# EasyEDA Pro project FPGA-G1.eprj, board logi Pi (continued)
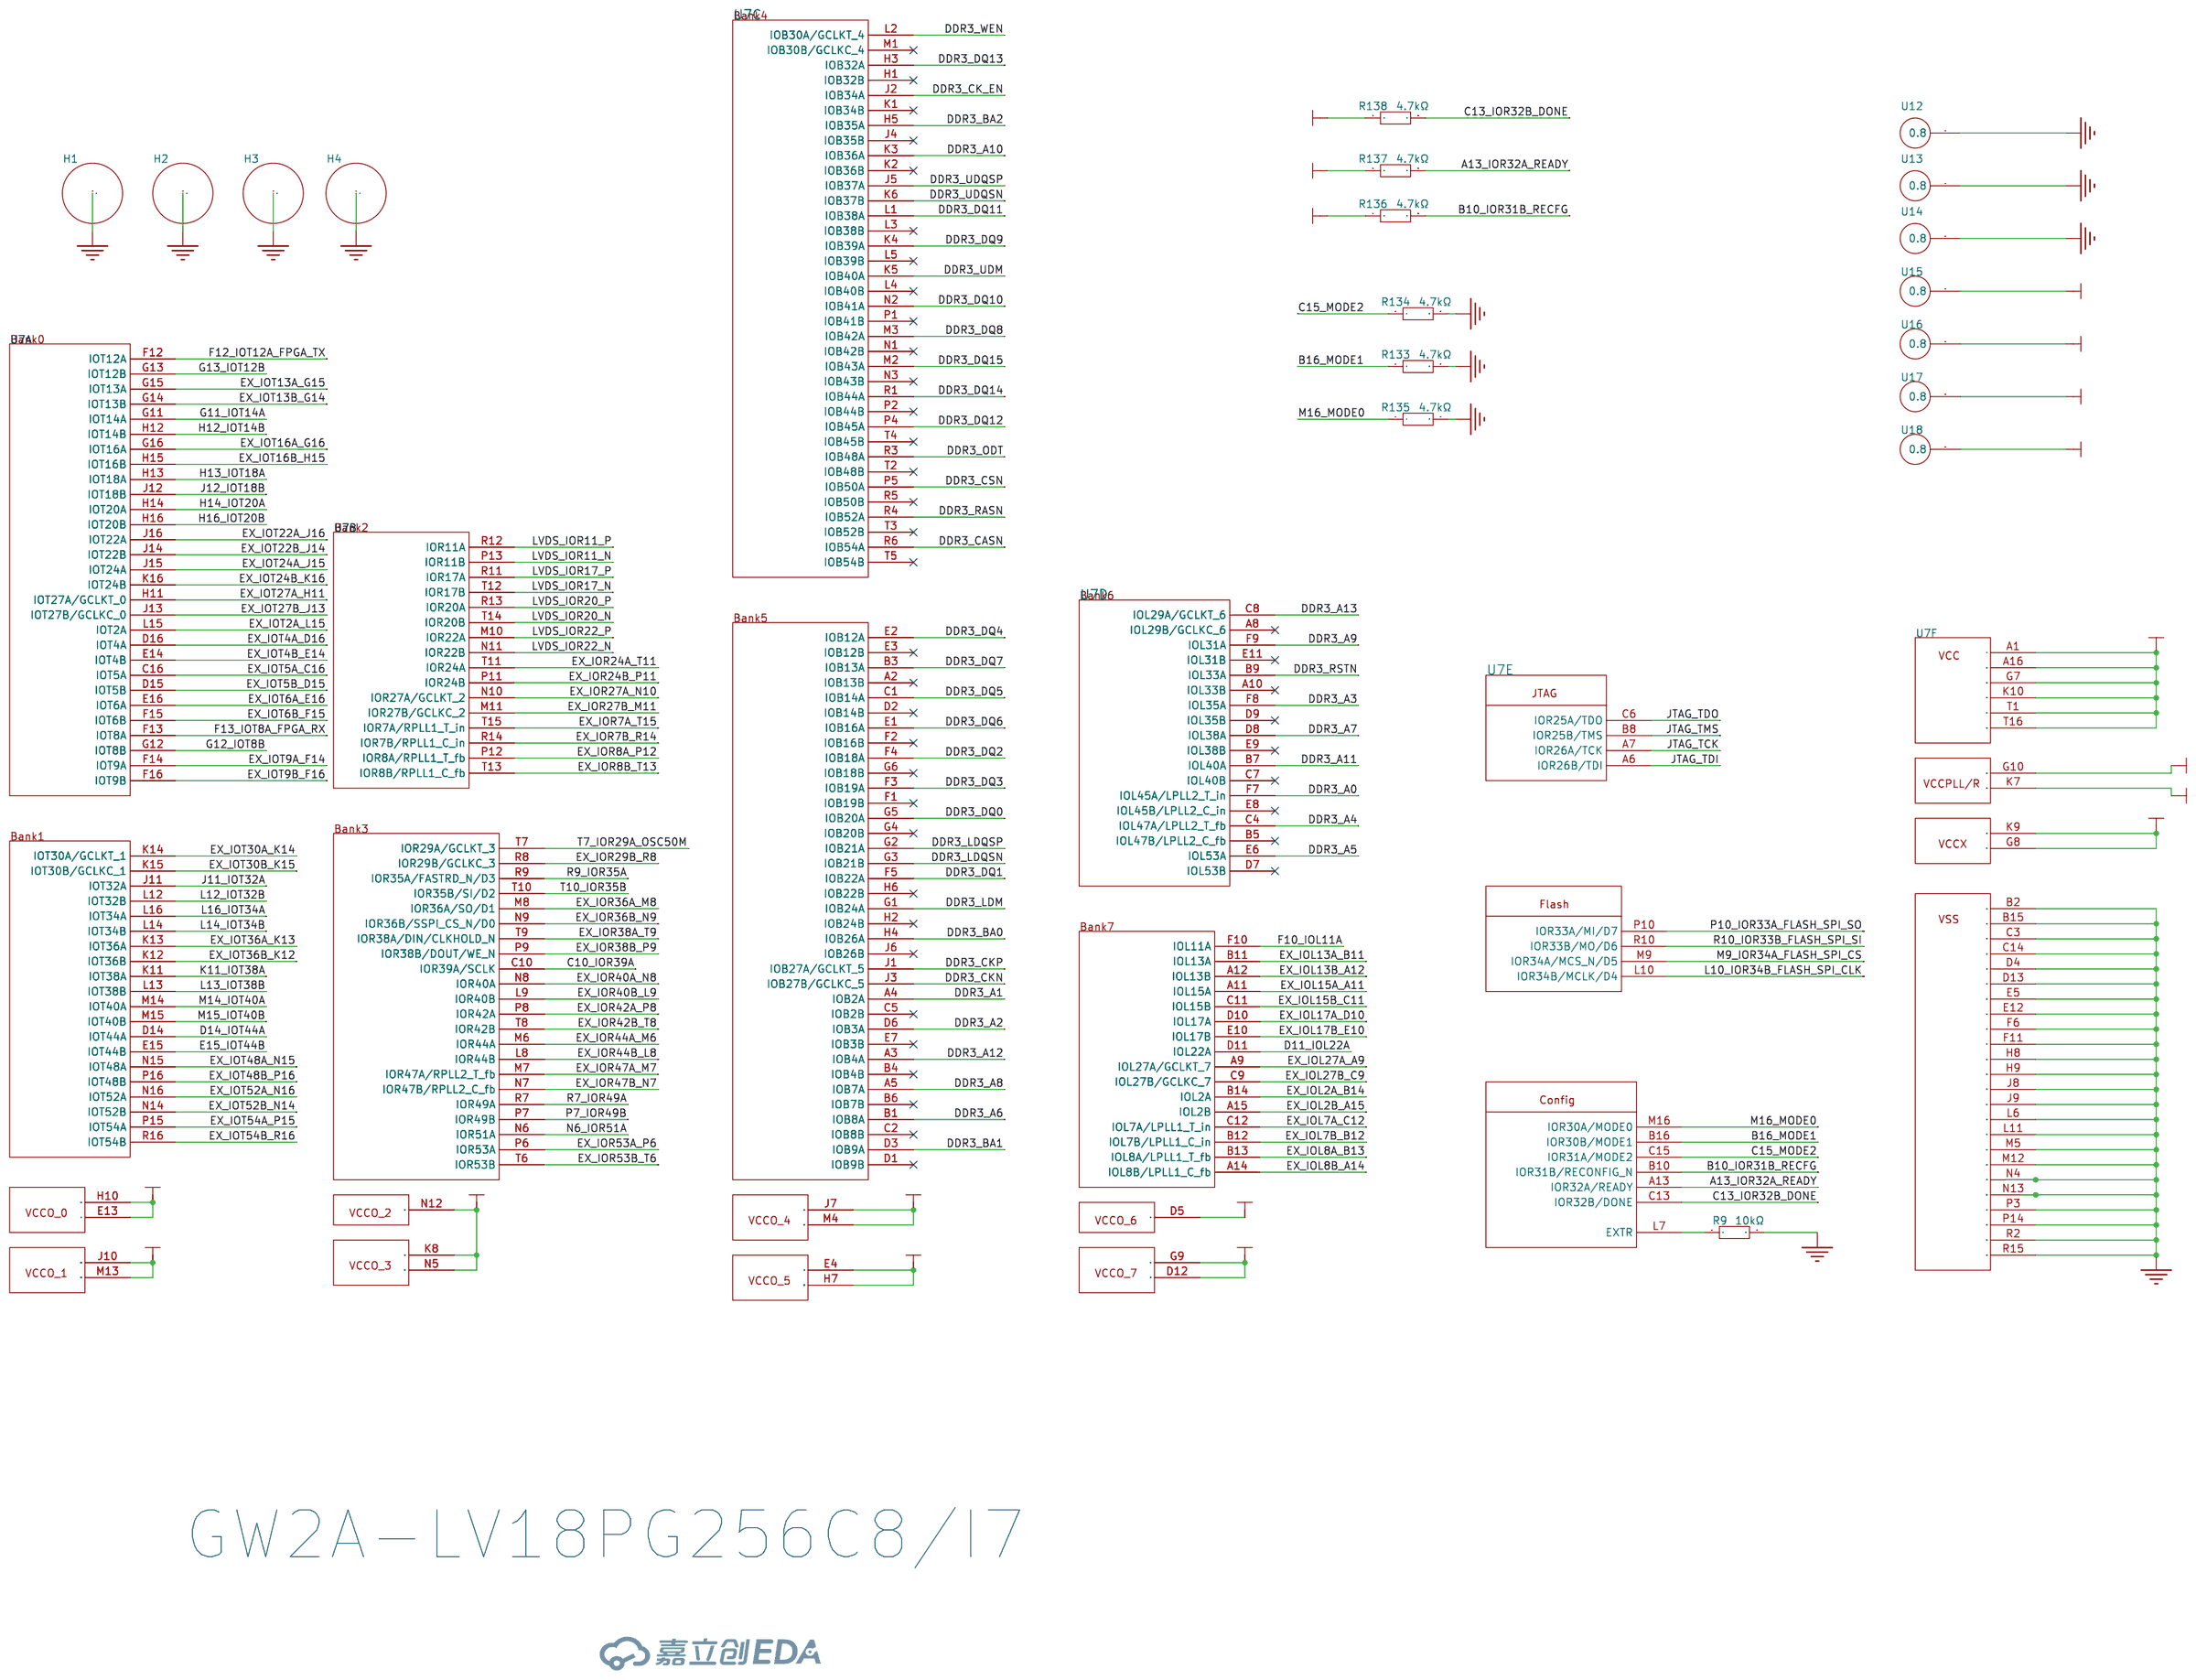
[diagram p0: FPGA]
## Routing (per net, layer and track width the routed paths; a pad name or vN(x,y) marks a point on that pad's centre or on a via; arc(x,y) is an arc through that point) (continued)
  SIG04 w0.104: 31.36,34.74 31.69,35.08 v1(31.71,35.08) ; 32.5,32.69 32.29,32.89 32.29,33.24 ; 41.57,25.03 41.57,24.49 41.46,24.38 40.61,24.38 40.37,24.63 40.37,26.01 40,26.37 38.28,26.37 37.9,26.75 37.9,32.55 36.48,33.98 35.29,33.98
EX_IOT48A_N15: length 22
  Top Layer w0.104: v1(35.7,31.09) 34.7,31.09 U7.N15
  SIG04 w0.104: v1(35.7,31.09) 36.05,30.74 36.05,30.28 36.49,29.84 36.49,29.23 36.74,28.98 36.91,28.98 36.98,28.91 36.98,28.73 36.91,28.65 36.74,28.65 36.49,28.4 36.49,27.97 36.74,27.71 36.91,27.71 36.98,27.64 36.98,27.46 36.91,27.39 36.74,27.39 36.49,27.13 36.49,26.7 36.74,26.45 36.91,26.45 36.98,26.38 36.98,26.2 36.91,26.12 36.74,26.12 36.49,25.87 36.49,25.44 36.74,25.18 36.91,25.18 36.98,25.11 36.98,24.93 36.91,24.86 36.74,24.86 36.49,24.61 36.49,24.17 36.74,23.92 36.91,23.92 36.98,23.85 36.98,23.67 36.91,23.59 36.74,23.59 36.49,23.34 36.49,21.71 36.78,21.42 37.43,21.42 37.95,21.95 37.95,23.14 38.42,23.61 40.07,23.61 40.15,23.53 40.15,22.56 40.07,22.49 H6.31
EX_IOT48B_P16: length 22
  Top Layer w0.104: v1(36.7,31.09) 36.2,30.59 U7.P16
  SIG04 w0.104: v1(36.7,31.09) 36.35,30.74 36.35,30.41 36.8,29.97 36.8,29.36 36.87,29.28 37.04,29.28 37.29,29.03 37.29,28.6 37.04,28.35 36.87,28.35 36.8,28.27 36.8,28.09 36.87,28.02 37.04,28.02 37.29,27.77 37.29,27.33 37.04,27.08 36.87,27.08 36.8,27.01 36.8,26.83 36.87,26.75 37.04,26.75 37.29,26.5 37.29,26.07 37.04,25.82 36.87,25.82 36.8,25.74 36.8,25.56 36.87,25.49 37.04,25.49 37.29,25.24 37.29,24.8 37.04,24.55 36.87,24.55 36.8,24.48 36.8,24.3 36.87,24.22 37.04,24.22 37.29,23.97 37.29,23.54 37.04,23.29 36.87,23.29 36.8,23.21 36.8,21.86 36.93,21.73 37.3,21.73 37.64,22.07 37.64,23.27 38.29,23.91 40.2,23.91 40.45,23.66 40.45,22.56 40.52,22.49 H6.32
EX_IOT52A_N16: length 22.1
  Top Layer w0.104: v1(35.7,32.09) U7.N16
  SIG04 w0.104: H6.35 40.07,17.41 40.15,17.34 40.15,16.69 39.77,16.32 38.49,16.32 34.64,20.17 34.64,31.03 v1(35.7,32.09)
EX_IOT52B_N14: length 22.1
  Top Layer w0.104: U7.N14 v1(33.7,31.09)
  SIG04 w0.104: H6.36 40.52,17.41 40.45,17.34 40.45,16.57 39.9,16.02 38.36,16.02 34.34,20.03 34.34,30.71 33.96,31.09 v1(33.7,31.09)
EX_IOT54A_P15: length 22.1
  Top Layer w0.104: v1(35.7,30.09) 34.7,30.09 U7.P15
  SIG04 w0.104: v1(35.7,30.09) 35.47,29.86 35.47,29.62 35.02,29.17 35.02,20.28 36.81,18.48 37.45,18.48 37.87,18.89 37.87,21.01 37.94,21.08 39.96,21.08 40.15,20.89 40.15,20.02 40.07,19.95 39.03,19.95
EX_IOT54B_R16: length 22.1
  Top Layer w0.104: v1(36.11,29.59) U7.R16
  SIG04 w0.104: v1(36.11,29.59) 35.87,29.36 35.64,29.36 35.32,29.04 35.32,20.4 36.94,18.78 37.33,18.78 37.56,19.02 37.56,21.13 37.81,21.38 40.09,21.38 40.45,21.02 40.45,19.53 40.69,19.29 41.39,19.29 41.57,19.47 41.57,19.95
EX_PA11: length 16.4
  Top Layer w0.109: 29.35,59.9 29.35,58.37 30.02,57.7 31.46,57.7 33.44,59.68 34.17,59.68 36.34,61.85 40.53,61.85 41.75,60.63
EX_PA12: length 13.8
  Top Layer w0.109: 38.69,60.31 37.75,61.26 36.25,61.26 34.32,59.32 33.59,59.32 31.62,57.36 29.8,57.36 28.84,58.32 28.84,59.74 28.76,59.82
EX_PB0: length 3.9
  Top Layer w0.109: 34.82,56 38.72,56
EX_PB9: length 18.1
  Top Layer w0.109: 26.28,54.44 26.66,54.44 27.02,54.8 27.02,55.38 28.51,56.87 31.55,56.87 v1(32.86,55.56)
  SIG04 w0.109: v1(32.86,55.56) 32.86,56.21 33.22,56.57 40.69,56.57 41.38,55.88
EX_PB10: length 7.6
  Top Layer w0.109: H6.4 41.57,57.88 40.63,56.95 38.02,56.95 37.55,57.42 34.71,57.42
EX_PB11: length 4.7
  Top Layer w0.109: H6.3 38.94,57.96 U1.22
F10_IOL11A: length 40.7
  Top Layer w0.109: 22.27,16.41 22.27,16.42 23.15,16.42 ; 23.15,16.42 23.16,16.42 ; 23.15,16.42 23.15,16.41 ; 23.16,16.42 23.15,16.41 ; 23.16,16.42 23.17,16.42 ; 23.16,16.42 23.17,16.42 23.17,16.42 ; 23.15,16.41 23.18,16.41 ; 23.18,16.41 23.17,16.42 ; 23.18,16.41 23.51,16.08 23.51,13.59 23.55,13.56 ; D7.2 22.2,18.61 v1(22.2,19.28) ; D7.2 22.9,18.6 SW3.2 ; D7.2 21.67,18.6 21.49,18.42 21.49,16.73 21.73,16.49 ; 22.23,16.63 22.16,16.56 ; 22.2,14.18 21.81,14.18 21.48,14.51 21.48,16.37 21.61,16.49 21.73,16.49 ; 21.73,16.49 22.08,16.49 22.17,16.41 ; U7.F10 29.7,39.09
  SIG04 w0.109: v1(22.2,19.28) 22.47,19.01 27,19.01 28.14,20.15 28.14,23.37 30.32,25.55 30.32,30.34 29.95,30.71 29.44,30.71 29.33,30.82 29.33,38.86 29.56,39.09 v1(29.72,39.09)
F12_IOT12A_FPGA_TX: length 36.4
  Top Layer w0.109: R18.2 v1(18.45,60.14) ; U7.F12 v1(31.7,39.09)
  SIG04 w0.109: v1(18.45,60.14) 18.45,59.58 20.71,57.33 20.71,52.46 22.09,51.08 25.46,51.08 26.61,52.23 31.88,52.23 32.63,51.49 32.63,48.99 32.35,48.71 32.35,46.42 31.57,45.64 31.57,43.75 31.32,43.5 31.32,39.48 v1(31.7,39.09)
F13_IOT8A_FPGA_RX: length 36.2
  Top Layer w0.109: U7.F13 v1(32.7,39.09) ; R19.2 v1(19.39,60.14)
  SIG04 w0.109: v1(19.39,60.14) 19.39,59.75 21.23,57.9 21.23,52.51 22.41,51.33 25.28,51.33 26.42,52.48 32.19,52.48 32.89,51.78 32.89,48.95 32.56,48.62 32.56,46.33 31.82,45.6 31.82,43.7 32.09,43.44 32.09,39.71 v1(32.7,39.09)
G11_IOT14A: length 28.3
  Top Layer w0.109: 19.46,50.85 20.21,50.85 ; U7.G11 v1(30.7,38.09)
  SIG04 w0.109: v1(20.21,50.86) 25.75,50.86 26.86,51.97 31.71,51.97 32.42,51.27 32.42,49.34 32.13,49.06 32.13,46.51 31.28,45.66 31.28,43.92 31.1,43.74 31.1,38.49 v1(30.7,38.09)
G12_IOT8B: length 31
  Top Layer w0.109: U7.G12 v1(31.7,38.09) ; v1(25.67,52.8) 25.67,52.28 25.6,52.21 24.93,52.21 24.68,51.95 22.42,51.95 21.82,51.35 19.46,51.35
  SIG04 w0.109: v1(31.7,38.09) 32.11,38.5 32.65,38.5 33.09,38.93 33.09,39.38 32.32,40.15 32.32,43.38 32.77,43.83 32.77,48.53 33.14,48.9 33.14,51.84 32.17,52.8 v1(25.67,52.8)
G13_IOT12B: length 30.7
  Top Layer w0.109: RN4.2 21.78,51.85 22.18,52.25 24.53,52.25 v1(25.08,52.8) ; U7.G13 v1(32.7,38.09)
  SIG04 w0.109: v1(25.08,52.8) 25.08,53.07 25.46,53.45 26.44,53.45 26.7,53.71 29.23,53.71 29.91,53.03 32.39,53.03 33.4,52.01 33.4,48.76 32.98,48.33 32.98,43.42 33.09,43.31 33.09,39.79 33.3,39.58 33.3,38.84 32.7,38.25 v1(32.7,38.09)
H12_IOT14B: length 29.7
  Top Layer w0.109: U7.H12 v1(30.7,37.09) ; 19.48,48.86 20.04,48.86 21.12,49.94
  SIG04 w0.109: 21.12,49.94 21.35,50.17 25.84,50.17 27.16,51.49 31.51,51.49 32,51.01 32,49.7 31.71,49.41 31.71,46.94 30.26,45.49 30.26,44.95 30.52,44.68 30.52,40.16 30.1,39.75 30.1,37.69 v1(30.7,37.09)
  vias: v1(21.12,49.96)
H13_IOT18A: length 30.7
  Top Layer w0.109: 19.46,49.36 19.72,49.36 v1(20.31,49.96) ; U7.H13 v1(31.7,37.09)
  SIG04 w0.109: v1(20.31,49.96) 20.86,50.5 25.76,50.5 26.96,51.71 31.6,51.71 32.21,51.09 32.21,49.56 31.92,49.27 31.92,46.8 30.48,45.36 30.48,45.03 30.83,44.68 30.83,40.04 30.32,39.53 30.32,37.88 30.59,37.61 31.19,37.61 v1(31.7,37.09)
H14_IOT20A: length 39.5
  Top Layer w0.109: 19.46,49.86 20.04,50.45 21.66,50.45 22.63,51.42 24.77,51.42 v1(25.07,51.72) ; U7.H14 v1(33.7,37.09)
  SIG04 w0.109: v1(33.7,37.09) 34.21,36.58 34.82,36.58 35.19,36.96 35.65,36.96 36.12,37.43 36.12,38.02 36.56,38.46 36.56,39.85 35.98,40.43 35.98,41.32 36.56,41.9 36.56,50.89 33.53,53.92 25.22,53.92 24.66,53.36 24.66,51.97 24.92,51.72 v1(25.07,51.72)
H16_IOT20B: length 36.4
  Top Layer w0.109: U7.H16 35.73,36.59 v1(35.7,36.57) ; 21.87,52.8 19.92,52.8 RN4.1
  SIG04 w0.109: v1(35.7,36.57) 35.82,36.57 36.9,37.65 36.9,51 33.77,54.13 26.78,54.13 26.22,54.69 22.27,54.69 21.87,54.29 v1(21.87,52.79)
HDMI_5V: length 7.1
  Top Layer w0.203: 9.94,7.86 10.18,7.86 10.35,7.69 10.35,7.44
  Top Layer w0.381: 7.96,7.86 7.97,7.85 9.94,7.85 9.94,7.86 ; v1(7.96,7.89) 7.6,8.25 v1(7.6,8.36) ; v1(7.79,11.09) 7.79,10.44 7.75,10.41 R152.2
  Bottom Layer w0.381: v1(7.96,7.89) 7.96,7.99 v1(7.6,8.36) ; 7.8,11.09 7.98,10.91 8.58,10.91 ; 8.8,9.81 8.79,9.83 8.79,10.58
HDMI_CLK_N: length 9.1
  Top Layer w0.104: R150.1 10.17,11.6 10.31,11.46 D10.5 10.31,9.09 10.26,9.05 v1(10.26,8.92) ; v1(11.27,4.75) 11.4,4.88 11.4,5.56 11.35,5.61 11.35,6.22
  Bottom Layer w0.104: v1(10.26,8.92) 10.39,8.79 10.39,8.56 11.4,7.56 11.4,4.88 v1(11.27,4.75)
HDMI_CLK_P: length 9.1
  Top Layer w0.104: v1(10.83,8.92) 10.83,9.05 10.81,9.08 D10.4 10.81,11.49 10.92,11.6 R149.1 ; 11.75,6.22 11.75,5.61 11.7,5.56 11.7,4.88 v1(11.83,4.75)
  Bottom Layer w0.104: v1(10.83,8.92) 10.7,8.79 10.7,8.69 11.7,7.69 11.7,4.88 v1(11.83,4.75)
HDMI_DATA0_N: length 4.4
  Top Layer w0.104: R148.1 11.66,11.33 11.81,11.19 D10.2 11.81,8.92 11.94,8.79 USB3.11
HDMI_DATA0_P: length 4.3
  Top Layer w0.104: 12.41,11.72 12.41,11.6 12.31,11.49 D10.1 12.31,8.85 12.34,8.82 USB3.9
HDMI_DATA1_N: length 8.8
  Top Layer w0.104: v1(13.19,8.92) 13.19,9.05 13.2,9.07 D9.6 D9.5 13.2,11.55 13.16,11.6 R146.1 ; 12.58,4.86 12.54,4.86 12.54,6.21
  Bottom Layer w0.104: v1(12.46,4.75) 12.58,4.88 12.58,7.04 13.32,7.78 13.32,8.79 v1(13.19,8.92)
HDMI_DATA1_P: length 8.9
  Top Layer w0.104: R145.1 13.9,11.6 13.7,11.4 D9.4 D9.7 13.7,9.1 13.76,9.05 v1(13.76,8.92) ; 12.89,4.86 12.94,4.86 12.94,6.21
  Bottom Layer w0.104: v1(13.02,4.75) 12.93,4.84 12.93,6.96 13.62,7.65 13.62,8.79 v1(13.76,8.92)
HDMI_DATA2_N: length 5.5
  Top Layer w0.104: USB3.5 13.14,8.19 13.44,8.49 14.33,8.49 14.7,8.86 D9.9 D9.2 14.7,11.54 14.65,11.6 14.65,11.72
HDMI_DATA2_P: length 5.6
  Top Layer w0.104: USB3.3 13.54,8.06 13.66,8.18 14.53,8.18 15.2,8.85 D9.10 D9.1 15.2,11.41 15.39,11.6 R143.1
J11_IOT32A: length 24.4
  Top Layer w0.109: 30.75,36.1 30.24,35.59 U7.J11 ; 35.69,49.06 TP2.1 35.43,50.08 33.56,50.08 32.34,51.3
  SIG04 w0.109: v1(35.7,49.06) 36.16,48.6 36.16,41.94 35.79,41.57 35.4,41.57 35.1,41.27 35.1,40.51 36.16,39.45 36.16,38.62 35.09,37.55 33.57,37.55 33.24,37.23 33.24,37.07 31.86,35.69 31.16,35.69 v1(30.75,36.11)
J12_IOT18B: length 22.1
  Top Layer w0.109: 32.71,49.46 32.68,49.42 ; 32.97,49.48 32.97,50.06 32.39,50.65 32.18,50.65 31.88,50.94 31.88,51.46 ; 32.97,49.48 TP1.1 ; 32.97,49.48 32.97,49.46 ; 35.23,49.63 34.29,49.63 34.04,49.38 33.37,49.38 33.12,49.63 ; 31.7,36.1 31.2,35.6 U7.J12
  SIG04 w0.109: 35.23,49.63 34.8,49.2 34.8,40.52 35.09,40.23 35.09,38.84 34.72,38.48 33.54,38.48 33.32,38.25 33.32,37.72 33.07,37.48 32.54,37.48 32.32,37.25 32.32,36.44 31.98,36.11 v1(31.7,36.11)
  vias: v1(35.26,49.63)
JTAG_TCK: length 22.4
  Top Layer w0.109: 24.03,46.08 24,46.08 23.97,46.05 26.2,43.82 U7.A7 ; RN1.6 15.78,60.35 16.02,60.11
  Bottom Layer w0.109: 24.03,46.08 24.15,46.2 24.15,53.18 17.67,59.66 16.47,59.66 v1(16.02,60.12)
  vias: v1(24.05,46.08)
JTAG_TDI: length 20.9
  Top Layer w0.109: 17.37,58.67 17.37,59.57 16.28,60.66 RN1.5 ; U7.A6 25.2,44.11 v1(23.26,46.05)
  Bottom Layer w0.109: v1(23.26,46.05) 23.26,48.16 22.25,49.17 22.25,53.78 17.45,58.59 v1(17.45,58.67)
JTAG_TDO: length 24.5
  Top Layer w0.109: RN1.7 15.28,60.11 ; U7.C6 24.66,42.13 24.66,43.99 v1(23.26,45.39)
  Bottom Layer w0.109: v1(23.26,45.39) 23.32,45.39 23.66,45.73 23.66,48.45 23.04,49.07 23.04,53.65 17.35,59.34 16.07,59.34 15.29,60.12 v1(15.28,60.12)
JTAG_TMS: length 26.3
  Top Layer w0.109: 14.43,60.09 14.78,60.44 RN1.8 ; v1(24.73,46.07) 24.73,45.72 26.72,43.73 26.72,42.92 27.05,42.59 U7.B8
  Bottom Layer w0.109: v1(14.43,60.12) 14.94,60.62 17.53,60.62 17.87,60.29 17.87,60.01 24.56,53.32 24.56,48.1 24.73,47.93 v1(24.73,46.07)
K11_IOT38A: length 23.8
  Top Layer w0.109: v1(35.31,51.26) 34.86,50.8 TP3.1 34.31,50.78 33.22,50.78 32.85,51.15 32.85,51.52 ; 29.69,35.12 30.2,34.61 U7.K11
  SIG04 w0.109: v1(35.31,51.26) 34.12,50.06 34.12,38.85 33.95,38.69 33.46,38.69 33.09,38.32 33.09,37.87 32.92,37.7 32.35,37.7 32.1,37.45 32.1,36.87 31.85,36.62 30.6,36.62 30.16,36.18 30.16,35.54 29.75,35.12 v1(29.72,35.12)
L10_IOR34B_FLASH_SPI_CLK: length 17.4
  Top Layer w0.109: v1(33.66,21.6) 33.66,21.81 34.46,22.62 35.42,22.62 ; U7.L10 v1(28.7,33.09)
  Bottom Layer w0.109: v1(28.7,33.09) 29.2,32.6 29.2,31.92 29.54,31.58 29.97,31.58 30.22,31.33 30.22,25.52 32.75,22.99 33.62,22.99 R151.2 33.66,21.6 v1(33.66,21.6)
L12_IOT32B: length 29.9
  Top Layer w0.109: 34.65,54.44 34.94,54.44 35.3,54.07 35.3,53.43 35.53,53.19 35.53,52.93 36.07,52.39 TP6.1 36.22,52.18 36.29,52.18 v1(36.63,51.84) ; U7.L12 v1(31.7,33.09)
  SIG04 w0.109: v1(36.63,51.84) 37.15,51.32 37.15,36.93 36.26,36.04 32.51,36.04 31.95,35.48 30.4,35.48 30.25,35.32 30.25,34.54 v1(31.7,33.09)
L13_IOT38B: length 28.9
  Top Layer w0.109: U7.L13 v1(32.7,33.09) ; 34.54,54.93 35.02,54.93 36.04,53.91 v1(36.11,53.91)
  SIG04 w0.109: v1(36.11,53.91) 36.11,52.9 37.41,51.61 37.41,36.59 36.62,35.8 32.57,35.8 32.09,35.33 32.09,34.6 32.7,33.99 v1(32.7,33.09)
L14_IOT34B: length 48.2
  Top Layer w0.109: U7.L14 v1(33.7,33.09) ; v1(27.44,54.52) 27.44,54.04 26.62,53.21 26.62,51.98 25.09,50.46 22.44,50.46 20.35,48.36 19.48,48.36
  SIG04 w0.109: v1(27.44,54.52) 36.05,54.52 36.58,53.99 36.58,52.97 37.67,51.88 37.67,36.41 36.76,35.5 32.57,35.5 32.31,35.24 32.31,34.72 33.7,33.33 v1(33.7,33.09)
L16_IOT34A: length 26
  Top Layer w0.109: U7.L16 35.95,33.59 36.62,34.26 36.62,34.29 36.84,34.52 36.87,34.52 v1(37.72,35.37) ; 34.78,55.45 36.22,55.45 v1(36.3,55.37)
  SIG04 w0.109: v1(36.3,55.37) 36.83,54.84 36.83,54.05 37.04,53.83 37.72,53.83 37.93,53.63 37.93,36.2 37.72,36 v1(37.72,35.37)
LCD_BLK: length 2.4
  Top Layer w0.254: 34.51,56.46 35.35,56.46 35.82,56.93
  Bottom Layer w0.254: 35.38,57.69 35.85,57.22 35.85,56.98 ; 35.84,56.96 35.83,56.96
  vias: v1(35.85,56.98)
LCD_CS: length 6.9
  Top Layer w0.109: 28.96,61.84 32.58,61.83 32.84,61.57 32.84,60.93 32.81,60.9 ; 27.55,63.47 27.55,63.26 28.96,61.85
LCD_DC: length 20.9
  Top Layer w0.109: 27.03,63.73 27.03,64.71 26.79,64.95 23.07,64.95 22.64,64.52 v1(22.64,62.57) ; 28.63,55.44 28.63,54.39 27.79,53.55 27.79,52.51
  SIG04 w0.109: 28.63,55.44 25.12,58.96 25.12,60.8 23.34,62.57 v1(22.64,62.57)
  vias: v1(28.63,55.47)
LCD_MISO: length 8.4
  Top Layer w0.109: 28.54,63.47 28.54,62.97 29.23,62.28 31.65,62.28 v1(31.94,62.57) ; v1(31.85,59.29) 31.85,59.94
  Bottom Layer w0.109: v1(31.94,62.57) 32.08,62.44 32.08,59.52 v1(31.85,59.29)
LCD_MOSI: length 11.2
  Top Layer w0.109: 31.85,58.67 31.3,59.22 31.3,59.88 ; 29.09,62.06 32.05,62.06 v1(32.56,62.57) ; 29.09,62.07 28.04,63.13 28.04,63.48
  Bottom Layer w0.109: 31.85,58.67 31.85,58.71 32.41,59.27 32.41,62.42 v1(32.56,62.57)
  vias: v1(31.85,58.67)
LCD_RST: length 12.7
  Top Layer w0.109: 26.02,63.48 26.02,62.97 26.42,62.57 v1(27.18,62.57) ; 33.7,56.96 32.83,56.96
  SIG04 w0.109: 32.77,56.95 29.95,56.95 26.68,60.22 26.68,61.63 27.18,62.13 v1(27.18,62.57)
  vias: v1(32.86,56.96)
LCD_SCK: length 7.6
  Top Layer w0.109: 26.53,64.01 26.53,63.29 26.77,63.05 27.39,63.05 28.82,61.62 28.98,61.62 28.99,61.61 32.14,61.62 32.36,61.4 32.36,61.13
LVDS_IOR11_N: length 53
  Top Layer w0.104: v1(14.73,13.53) 14.86,13.4 14.86,12.8 R144.2 ; U7.P13 v1(31.7,30.09)
  SIG03 w0.104: v1(14.73,13.53) 14.86,13.4 14.86,11.77 15.14,11.49 16.26,11.49 16.51,11.75 16.51,13.79 16.79,14.07 18.09,14.07 18.16,13.99 18.16,11.29 18.41,11.04 18.84,11.04 19.1,11.29 19.1,13.99 19.17,14.07 21.72,14.07 22.1,14.45 24.75,14.45 25.21,14.91 25.21,15.27 24.2,16.28 24.2,16.38 24.33,16.51 24.44,16.51 25.44,15.5 25.8,15.5 26.11,15.8 26.11,16.16 25.1,17.17 25.1,17.27 25.23,17.4 25.33,17.4 26.34,16.39 26.74,16.39 26.99,16.64 26.99,18.5 28.61,20.12 28.61,20.48 27.98,21.11 27.98,21.21 28.11,21.34 28.21,21.34 28.85,20.71 29.2,20.71 29.51,21.02 29.51,21.37 28.88,22 28.88,22.11 29,22.24 29.11,22.24 29.74,21.6 30.14,21.6 32.61,24.07 32.61,25.18 32.36,25.43 32.3,25.43 32.23,25.5 32.23,25.68 32.3,25.76 32.36,25.76 32.61,26.01 32.61,26.61 32.53,26.69 32.3,26.69 32.23,26.77 32.23,26.95 32.3,27.02 32.53,27.02 32.61,27.11 32.61,27.86 32.52,27.96 32.3,27.96 32.23,28.03 32.23,28.21 32.3,28.28 32.52,28.28 32.61,28.38 32.61,29.29 31.82,30.09 v1(31.7,30.09)
LVDS_IOR11_P: length 53
  Top Layer w0.104: v1(15.29,13.53) 15.16,13.4 15.16,12.82 R143.2 ; U7.R12 v1(31.7,29.09)
  SIG03 w0.104: v1(15.29,13.53) 15.16,13.4 15.16,11.98 15.35,11.79 15.5,11.79 15.57,11.87 15.57,12.66 15.65,12.73 15.83,12.73 15.9,12.66 15.9,11.87 15.98,11.79 16.13,11.79 16.21,11.87 16.21,13.91 16.67,14.37 18.21,14.37 18.47,14.12 18.47,11.42 18.54,11.35 18.72,11.35 18.79,11.42 18.79,14.12 19.04,14.37 21.5,14.37 21.88,14.75 23.58,14.75 23.66,14.83 23.66,15.12 23.73,15.19 23.91,15.19 23.99,15.12 23.99,14.83 24.06,14.75 24.62,14.75 24.91,15.04 24.91,15.14 23.9,16.15 23.9,16.51 24.21,16.81 24.56,16.81 25.57,15.8 25.67,15.8 25.8,15.93 25.8,16.04 24.79,17.04 24.79,17.4 25.1,17.71 25.46,17.71 26.47,16.7 26.57,16.7 26.57,16.75 26.69,16.86 26.69,18.62 28.26,20.2 28.26,20.4 27.68,20.98 27.68,21.34 27.98,21.65 28.34,21.65 28.97,21.01 29.08,21.01 29.2,21.14 29.2,21.25 28.57,21.88 28.57,22.23 28.88,22.54 29.23,22.54 29.87,21.91 29.97,21.91 32.31,24.25 32.31,24.99 31.92,25.38 31.92,25.81 32.3,26.18 32.3,26.27 31.92,26.64 31.92,27.13 32.25,27.46 32.25,27.58 31.92,27.91 31.92,28.34 32.31,28.72 32.31,29.13 32.21,29.24 31.76,29.24 31.67,29.14 31.67,29.12 31.7,29.09 v1(31.7,29.09)
LVDS_IOR17_N: length 53
  Top Layer w0.104: R146.2 13.38,12.82 13.38,13.38 v1(13.26,13.51) ; 30.7,28.1 30.71,28.1 U7.T12
  SIG03 w0.104: v1(13.26,13.51) 13.44,13.69 13.44,13.89 13.29,14.04 11.6,14.04 11.35,14.29 11.35,14.73 11.6,14.98 12.04,14.98 12.11,15.05 12.11,16.21 12.36,16.46 12.8,16.46 13.05,16.21 13.05,15.05 13.12,14.98 13.36,14.98 13.44,15.05 13.44,15.44 13.78,15.78 14.06,15.78 14.13,15.85 14.13,16 14.21,16.07 14.39,16.07 14.46,16 14.46,15.85 14.53,15.78 14.95,15.78 15.2,15.52 15.2,15.01 15.28,14.94 15.46,14.94 15.53,15.01 15.53,15.52 15.78,15.78 16.22,15.78 16.47,15.52 16.47,15.01 16.54,14.94 16.72,14.94 16.8,15.01 16.8,15.52 17.05,15.78 17.48,15.78 17.73,15.52 17.73,15.01 17.81,14.94 17.99,14.94 18.06,15.01 18.06,15.52 18.31,15.78 18.75,15.78 19,15.52 19,15.01 19.07,14.94 19.25,14.94 19.33,15.01 19.33,15.52 19.58,15.78 22.34,15.78 23.33,16.77 23.33,18.76 23.58,19.01 25.45,19.01 25.52,19.09 25.52,19.27 25.45,19.34 23.58,19.34 23.33,19.59 23.33,20.03 23.58,20.28 25.45,20.28 25.52,20.35 25.52,20.53 25.45,20.61 23.58,20.61 23.33,20.86 23.33,21.56 23.7,21.93 27.01,21.93 28.42,23.34 30.12,23.34 31.39,24.61 31.39,28.2 31.08,28.51 30.8,28.51 30.7,28.41 v1(30.7,28.12)
LVDS_IOR17_P: length 53
  Top Layer w0.104: U7.R11 30.2,29.56 30.67,29.1 ; R145.2 13.69,12.8 13.69,13.38 v1(13.82,13.51)
  SIG03 w0.104: v1(13.82,13.51) 13.74,13.58 13.74,14.09 13.49,14.35 11.73,14.35 11.66,14.42 11.66,14.6 11.73,14.67 12.16,14.67 12.42,14.93 12.42,16.08 12.49,16.16 12.67,16.16 12.74,16.08 12.74,14.93 13,14.67 13.49,14.67 13.74,14.93 13.74,15.31 13.9,15.47 14.83,15.47 14.9,15.4 14.9,14.88 15.15,14.63 15.59,14.63 15.84,14.88 15.84,15.4 15.91,15.47 16.09,15.47 16.16,15.4 16.16,14.88 16.42,14.63 16.85,14.63 17.1,14.88 17.1,15.4 17.18,15.47 17.36,15.47 17.43,15.4 17.43,14.88 17.68,14.63 18.11,14.63 18.37,14.88 18.37,15.4 18.44,15.47 18.62,15.47 18.69,15.4 18.69,14.88 18.95,14.63 19.38,14.63 19.63,14.88 19.63,15.4 19.71,15.47 22.47,15.47 23.63,16.64 23.63,18.63 23.71,18.71 25.58,18.71 25.83,18.96 25.83,19.39 25.58,19.65 23.71,19.65 23.63,19.72 23.63,19.9 23.71,19.97 25.58,19.97 25.83,20.23 25.83,20.66 25.58,20.91 23.71,20.91 23.63,20.98 23.63,21.43 23.83,21.62 27.14,21.62 28.53,23.02 30.38,23.02 31.71,24.35 31.71,28.31 31.12,28.9 30.81,28.9 30.71,29 v1(30.71,29.1)
LVDS_IOR20_N: length 53
  Top Layer w0.104: v1(11.76,13.49) 11.89,13.36 11.89,12.82 R148.2 ; U7.T14 v1(33.2,28.12)
  SIG03 w0.104: v1(33.2,28.12) 33.58,27.74 33.58,27.31 33.24,26.97 33.24,26.73 33.32,26.66 33.63,26.66 33.88,26.4 33.88,25.97 33.63,25.72 33.32,25.72 33.24,25.65 33.24,24.19 33.32,24.11 33.61,24.11 33.86,23.86 33.86,23.43 33.61,23.17 33.32,23.17 33.24,23.1 33.24,22.66 32.95,22.37 32.6,22.37 32.22,22.74 32.12,22.74 31.99,22.61 31.99,22.51 32.36,22.14 32.36,21.78 32.06,21.47 31.7,21.47 31.33,21.85 31.23,21.85 31.1,21.72 31.1,21.61 31.47,21.24 31.47,20.89 31.16,20.58 30.81,20.58 30.44,20.95 30.33,20.95 30.2,20.82 30.2,20.72 30.58,20.35 30.58,19.99 30.27,19.68 29.91,19.68 29.54,20.06 29.44,20.06 29.31,19.93 29.31,19.82 29.68,19.45 29.68,19.1 29.37,18.79 29.02,18.79 28.65,19.16 28.54,19.16 28.41,19.03 28.41,18.93 29.23,18.11 29.23,17.66 28.98,17.41 28.54,17.41 28.46,17.34 28.46,17.16 28.54,17.08 28.98,17.08 29.23,16.83 29.23,16.4 28.98,16.15 28.39,16.15 28.31,16.07 28.31,15.89 28.39,15.82 28.98,15.82 29.23,15.57 29.23,15.15 27.46,13.39 27.07,13.39 26.82,13.64 26.82,14.86 26.75,14.93 26.56,14.93 26.49,14.86 26.49,13.64 26.24,13.39 22.81,13.39 19.43,10.01 12.73,10.01 11.89,10.84 11.89,13.36 v1(11.76,13.49)
LVDS_IOR20_P: length 53
  Top Layer w0.104: R147.2 12.2,12.8 12.2,13.36 v1(12.32,13.49) ; 33.16,27.56 32.7,28.03 32.7,28.85 32.2,29.35 U7.R13
  SIG03 w0.104: 33.16,27.56 32.94,27.34 32.94,26.6 33.19,26.35 33.5,26.35 33.58,26.28 33.58,26.1 33.5,26.02 33.19,26.02 32.94,25.77 32.94,24.06 33.19,23.81 33.48,23.81 33.55,23.73 33.55,23.55 33.48,23.48 33.19,23.48 32.94,23.23 32.94,22.79 32.83,22.67 32.72,22.67 32.35,23.04 31.99,23.04 31.69,22.74 31.69,22.38 32.06,22.01 32.06,21.91 31.93,21.78 31.83,21.78 31.46,22.15 31.1,22.15 30.79,21.84 30.79,21.49 31.16,21.12 31.16,21.01 31.04,20.88 30.93,20.88 30.56,21.26 30.21,21.26 29.9,20.95 29.9,20.59 30.27,20.22 30.27,20.12 30.14,19.99 30.04,19.99 29.67,20.36 29.31,20.36 29,20.06 29,19.7 29.38,19.33 29.38,19.22 29.25,19.1 29.14,19.1 28.77,19.47 28.42,19.47 28.11,19.16 28.11,18.8 28.93,17.99 28.93,17.79 28.85,17.72 28.41,17.72 28.16,17.46 28.16,17.03 28.41,16.78 28.85,16.78 28.93,16.71 28.93,16.53 28.85,16.45 28.26,16.45 28.01,16.2 28.01,15.77 28.26,15.51 28.85,15.51 28.93,15.44 28.93,15.28 27.34,13.69 27.2,13.69 27.12,13.76 27.12,14.99 26.87,15.24 26.44,15.24 26.19,14.99 26.19,13.76 26.11,13.69 22.69,13.69 19.31,10.31 13.07,10.31 12.2,11.19 12.2,13.36 v1(12.32,13.49)
  vias: v1(33.2,27.56)
LVDS_IOR22_N: length 53
  Top Layer w0.104: U7.N11 29.7,31.09 ; v1(10.26,13.5) 10.39,13.37 10.39,12.81 R150.2
  SIG03 w0.104: 29.7,31.09 29.7,31.28 29.79,31.37 30.23,31.37 30.53,31.06 31.27,31.06 34.1,28.24 34.1,23.12 29.56,18.58 29.56,15.01 27.61,13.06 23.1,13.06 19.73,9.69 12.04,9.69 11.97,9.77 11.97,9.87 11.89,9.94 11.71,9.94 11.64,9.87 11.64,9.77 11.56,9.69 11.38,9.69 11.31,9.77 11.31,9.87 11.24,9.94 11.06,9.94 10.98,9.87 10.98,9.77 10.91,9.69 10.73,9.69 10.65,9.77 10.65,9.96 10.58,10.03 10.4,10.03 10.33,9.96 10.33,9.77 10.25,9.69 10.01,9.69 9.08,10.62 9.08,11.15 9.16,11.23 9.37,11.23 9.44,11.3 9.44,11.48 9.37,11.56 9.16,11.56 9.08,11.63 9.08,11.81 9.16,11.88 9.37,11.88 9.44,11.96 9.44,12.14 9.37,12.21 9.16,12.21 9.08,12.28 9.08,12.46 9.16,12.54 9.37,12.54 9.44,12.61 9.44,12.79 9.37,12.87 9.16,12.87 9.08,12.94 9.08,13.43 9.46,13.8 10.19,13.8 10.26,13.73 v1(10.26,13.5)
  vias: v1(29.72,31.09)
LVDS_IOR22_P: length 53
  Top Layer w0.104: v1(10.82,13.5) 10.7,13.37 10.7,12.81 R149.2 ; U7.M10 29.7,32.09
  SIG03 w0.104: 29.7,32.09 29.7,31.99 29.81,31.88 30.14,31.88 30.66,31.37 31.4,31.37 34.42,28.35 34.42,22.9 29.86,18.34 29.86,14.88 27.74,12.75 23.4,12.75 20.03,9.39 9.88,9.39 8.78,10.49 8.78,13.58 9.31,14.11 10.44,14.11 10.7,13.86 10.7,13.62 v1(10.82,13.5)
  vias: v1(29.72,32.09)
M9_IOR34A_FLASH_SPI_CS: length 9.4
  Top Layer w0.109: 28.35,25.17 27.44,25.17 27,25.61 v1(27,25.95) ; U7.M9 v1(28.7,32.09)
  Bottom Layer w0.109: v1(27,25.95) 27,28.49 28.24,29.73 28.24,31.62 v1(28.7,32.09)
M14_IOT40A: length 34.3
  Top Layer w0.102: USB2.8 32.66,8.39 32.56,8.49 31.54,8.49 31.53,8.5 ; USB2.6 31.66,8.06 31.53,8.19 31.53,8.97 31.99,9.44 E2.2 ; E2.2 32.15,9.44 ; E2.2 31.55,9.98 31.55,11.44 31.26,11.73 30.97,11.73 v1(30.8,11.9) ; U7.M14 v1(33.7,32.09) ; R177.1 32.97,9.47 32.25,9.47
  SIG03 w0.102: v1(30.8,11.9) 30.96,11.74 31.61,11.74 31.87,12 31.87,18.71 32.93,19.77 34.71,19.77 36.08,21.15 36.08,28.45 34.71,29.83 34.71,30.89 34.08,31.51 34.08,31.71 v1(33.7,32.09)
M15_IOT40B: length 34.3
  Top Layer w0.102: 32.2,7.09 32.19,7.08 32.19,6.71 32.07,6.58 31.27,6.58 31.16,6.69 USB2.5 31.16,8.06 31.26,8.16 31.26,8.97 30.78,9.45 E1.2 31.31,10 31.31,11.2 31.03,11.48 30.94,11.48 30.78,11.32 30.78,11.31 ; U7.M15 v1(34.7,32.09)
  SIG03 w0.102: v1(30.8,11.31) 30.98,11.48 31.68,11.48 32.11,11.91 32.11,15.96 32.18,16.03 32.34,16.03 32.41,16.11 32.41,16.29 32.34,16.36 32.18,16.36 32.11,16.43 32.11,16.62 32.18,16.69 32.34,16.69 32.41,16.76 32.41,16.95 32.34,17.02 32.18,17.02 32.11,17.09 32.11,18.62 33.01,19.52 34.78,19.52 36.32,21.05 36.32,28.55 34.94,29.93 34.94,30.99 34.32,31.61 34.32,31.71 v1(34.7,32.09)
M16_MODE0: length 1.6
  Top Layer w0.109: 35.33,32.63 36.9,32.63 36.91,32.64
N6_IOR51A: length 13.9
  Top Layer w0.109: 21.04,25.26 v1(21.04,26.31) ; U7.N6 v1(24.7,31.09)
  SIG04 w0.109: v1(24.7,31.09) 25.06,31.09 25.46,30.69 26.79,30.69 27.1,30.39 27.1,27.52 25.89,26.31 v1(21.04,26.31)
NRST: length 15.9
  Top Layer w0.109: 23.84,61.78 23.84,61.31 25.33,59.81 v1(25.82,59.81) ; v1(29.31,55.48) 30.34,54.45 U1.7
  SIG04 w0.109: v1(25.82,59.81) 25.82,58.98 v1(29.31,55.48)
  Bottom Layer w0.109: C167.2 27.63,59.53 R2.1 26.15,59.48 v1(25.82,59.81)
OSCIN: length 6.2
  Top Layer w0.254: 29.35,51.41 29.35,50.57 29.19,50.41 ; 29.31,50.28 29.31,49.65 29.13,49.46 ; 29.07,49.52 29.13,49.46 ; 29.13,49.46 29.57,49.02 29.57,47.1 28.76,46.29 28.3,46.29 ; 29.13,49.46 29.09,49.43
OSCOUT: length 3.3
  Top Layer w0.254: 30.22,50.35 30.22,49.6 ; 30.21,50.41 29.87,50.76 29.87,51.42 ; 30.18,49.52 30.18,48.68 30.61,48.26
P7_IOR49B: length 12.2
  Top Layer w0.109: U7.P7 v1(25.7,30.09) ; 19.22,25.26 v1(19.22,25.64)
  SIG04 w0.109: v1(19.22,25.64) 19.22,26.46 19.55,26.79 24.24,26.79 24.42,26.61 25.09,26.61 25.29,26.81 25.29,27.31 26.17,28.19 26.17,29.71 25.8,30.09 v1(25.7,30.09)
